# EasyEDA Pro project Geacon3.eprj, board Geacon_1 (continued)
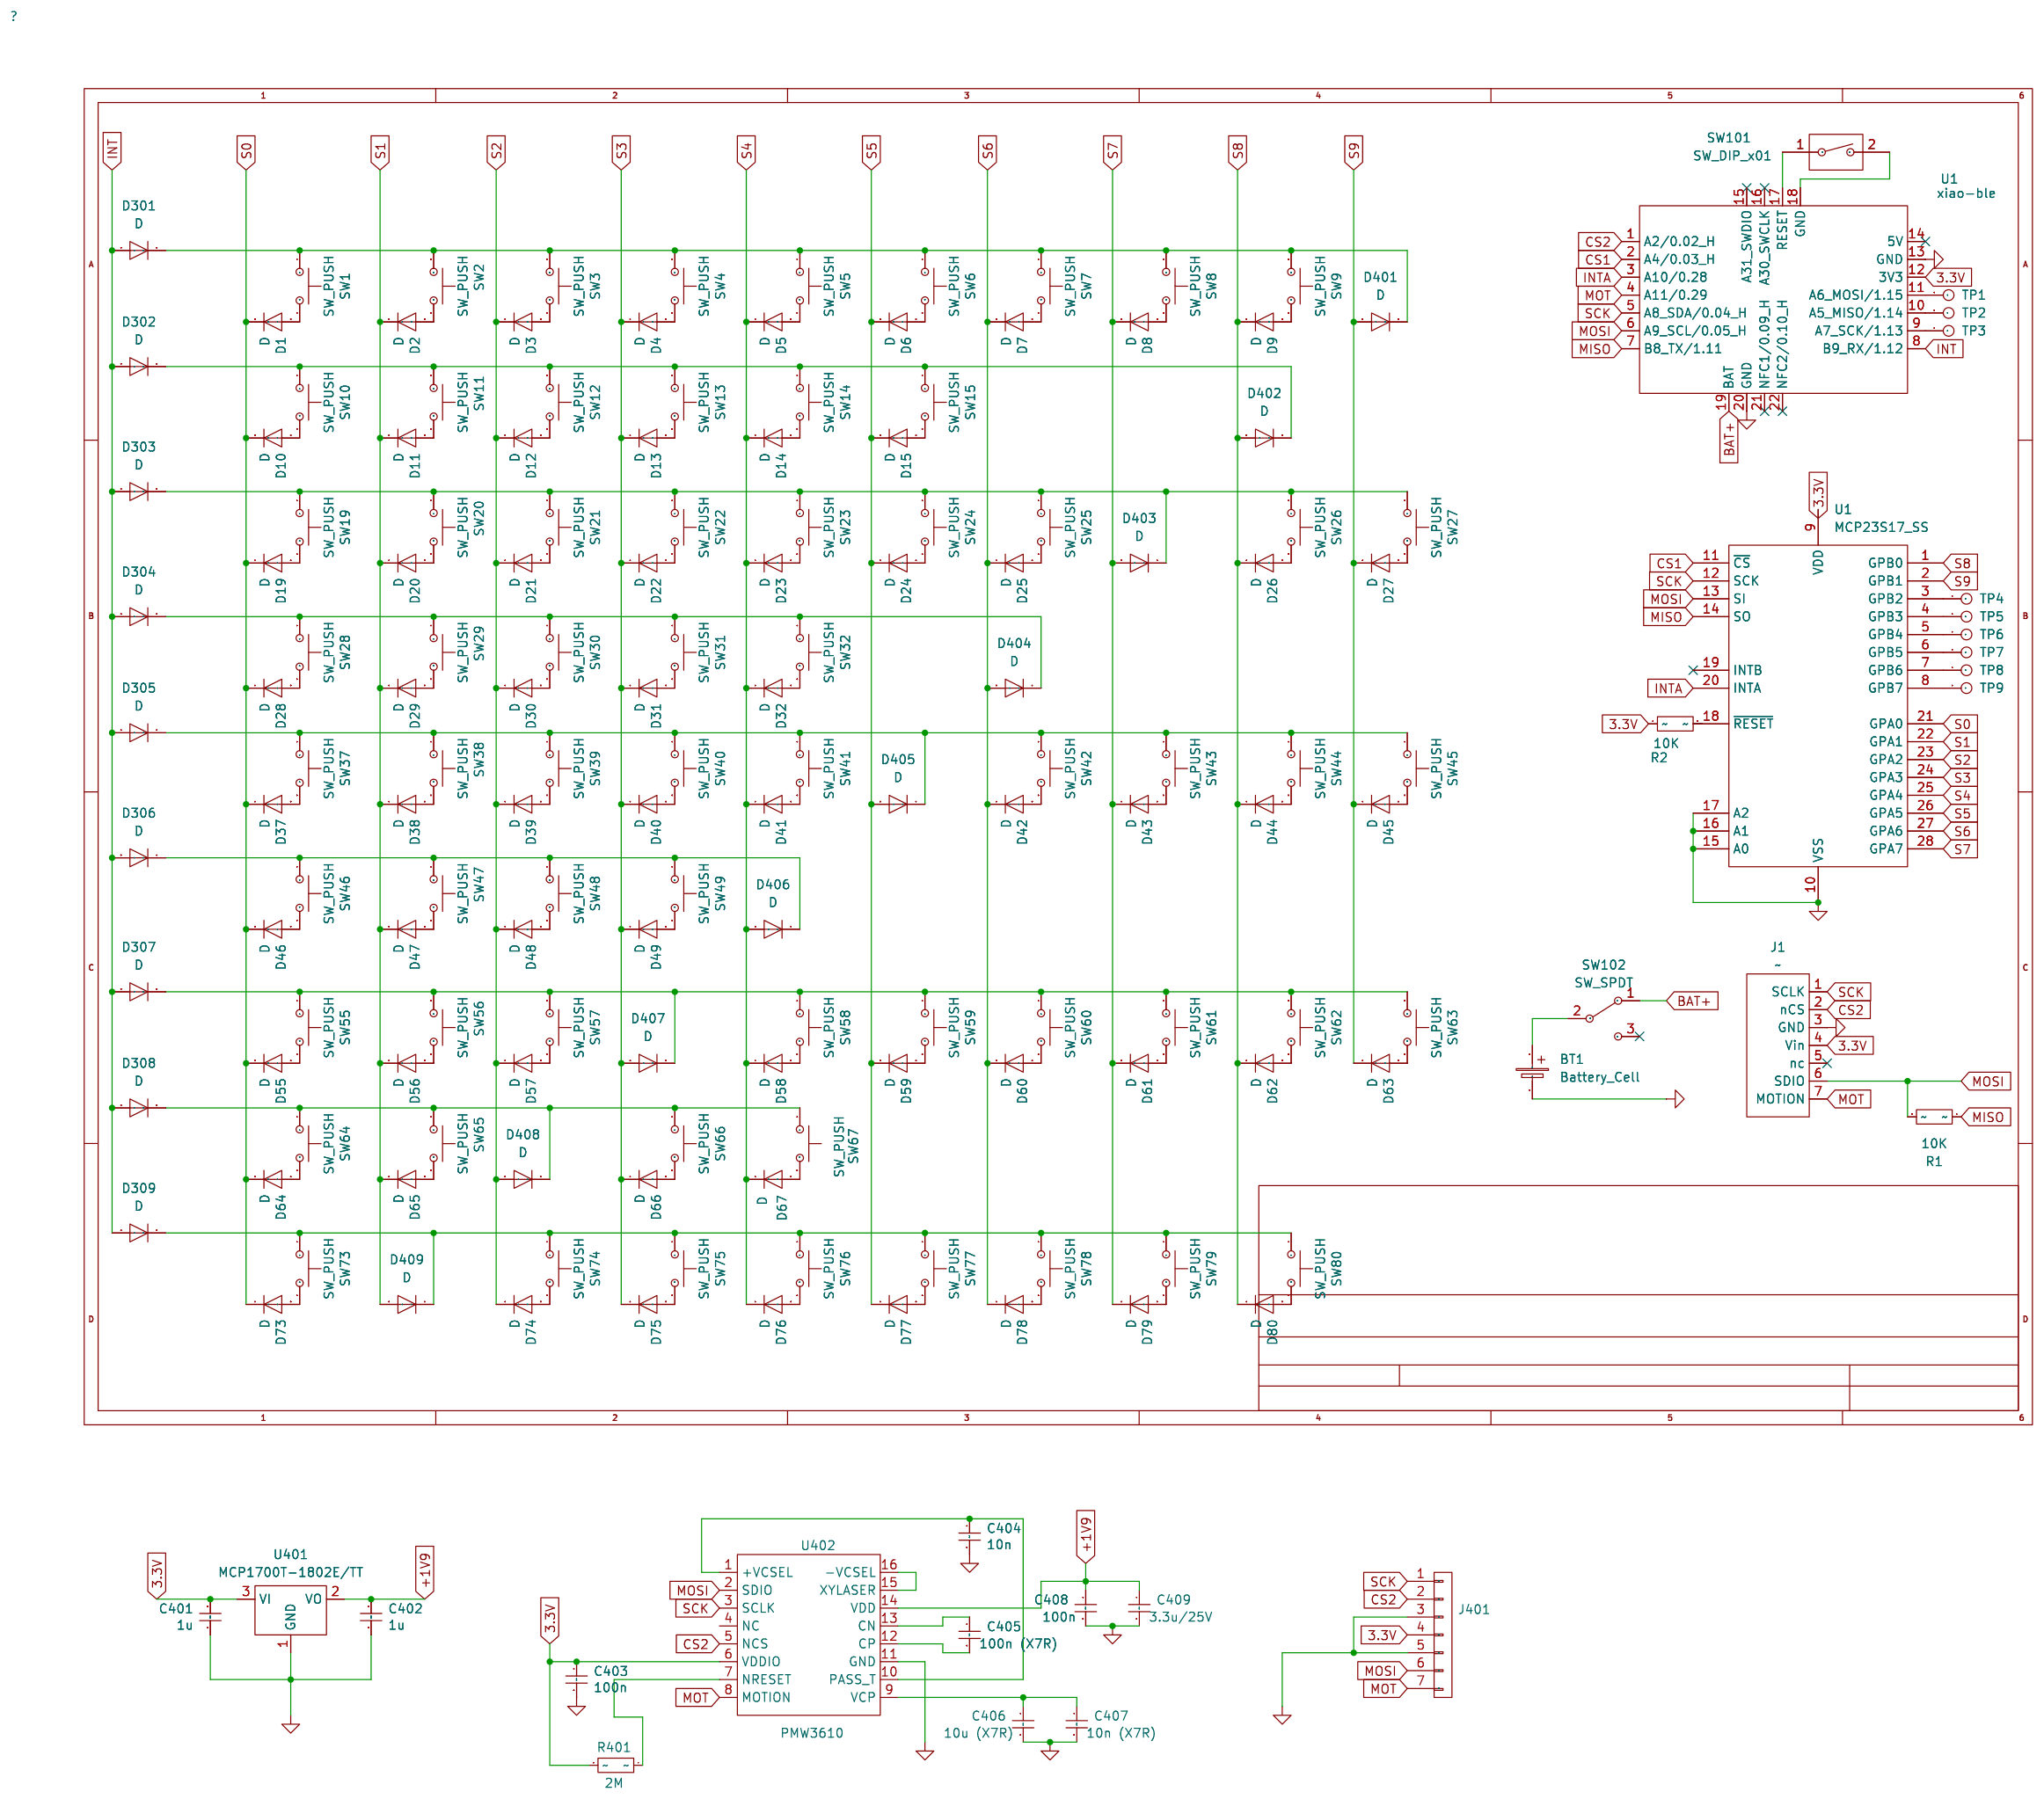
[diagram p0: schematic sheet]
## Routing (per net, layer and track width the routed paths; a pad name or vN(x,y) marks a point on that pad's centre or on a via; arc(x,y) is an arc through that point) (continued)
  Bottom Layer w0.25: 60.59,113.62 60.05,113.08 57.17,113.08 55.92,114.32 v1(55.92,115.95) ; v1(58.36,117.5) 58.47,117.6 62.27,117.6 64.67,115.2 72.3,115.2 72.44,115.06 v1(72.44,114.68) ; 128.93,106.19 102.23,106.19 101.93,106.49 100.09,106.49 99.79,106.19 97.15,106.19 96.85,106.49 88.66,106.49 88.36,106.19 82.99,106.19 v1(82.59,105.79)
MOSI: length 408.8
  Top Layer w0.25: v1(58.46,115.95) 60.03,115.95 62.57,118.49 62.57,118.88 63.03,119.34 63.59,119.34 63.65,119.28 65.6,119.28 69.01,122.68 82.88,122.68 89.23,116.33 118.09,116.33 121.68,112.73 121.68,111.55 121.29,111.15 121.29,110.59 122.23,109.65 127.29,109.65 133.32,103.62 144.22,103.62 147.09,106.5 165.85,106.5 168.86,109.51 v1(168.86,113.51) ; v1(237.15,16.22) 237.15,17.78 246.43,27.05 v1(246.43,28.32)
  Bottom Layer w0.25: v1(168.86,113.51) 168.98,113.63 286.19,113.63 291.38,108.44 291.38,39.41 280.78,28.81 246.91,28.81 v1(246.43,28.32) ; v1(237.15,16.22) 237.15,11.41 234.96,9.21 J1.6 ; v1(58.46,115.95) 58.72,115.95 59.59,115.08 61.14,115.08 61.24,114.98 61.24,112.66 60.79,112.21 56.57,112.21 56.28,112.5 55.92,112.5
MOT: length 318.6
  Top Layer w0.25: v1(244.18,28.13) 244.18,27.34 v1(237.83,20.99) ; 128.93,113.81 131.86,110.87 v1(134.66,110.87)
  Bottom Layer w0.25: J1.7 234.96,6.67 237.83,9.54 v1(237.83,20.99) ; v1(244.18,28.13) 245.66,29.62 280.45,29.62 290.57,39.74 290.57,108.11 285.86,112.82 169.7,112.82 169.02,112.14 168.96,112.14 160.44,103.62 139.95,103.62 134.66,108.91 v1(134.66,110.87)
NET-(BT1-+): length 25.4
  Top Layer w1: v1(30.03,118.03) 31.17,116.89 BT1.1
  Bottom Layer w1: v1(30.03,118.03) 29.8,118.26 SW102.2
NET-(D1-A): length 11.5
  Bottom Layer w0.25: SW1.2 18.41,107.17 18.45,107.21 19.2,106.46 19.2,100.25 18.45,99.49
NET-(D2-A): length 11.5
  Bottom Layer w0.25: 37.45,99.49 38.25,100.3 38.25,106.46 37.49,107.21 37.45,107.17 SW2.2
NET-(D3-A): length 11.7
  Bottom Layer w0.25: SW3.2 56.81,106.52 57.39,105.93 57.39,99.94 56.04,98.59
NET-(D4-A): length 11.9
  Bottom Layer w0.25: SW4.2 76,104.16 76.44,103.72 76.44,97.69 75.05,96.29 74.45,96.29
NET-(D5-A): length 12.5
  Bottom Layer w0.25: SW5.2 94.89,100.37 95.47,99.8 95.47,94.11 93.45,92.09 92.84,92.09
NET-(D6-A): length 11.9
  Bottom Layer w0.25: 112.65,89.59 114.28,91.22 114.28,97.23 114.08,97.43 113.77,97.74 SW6.2
NET-(D7-A): length 11.6
  Bottom Layer w0.25: 132.34,88.99 133.46,90.11 133.46,96.06 132.82,96.71 132.79,96.74 SW7.2
NET-(D8-A): length 11.5
  Bottom Layer w0.25: 152.25,89.94 152.64,90.34 152.64,96.52 151.55,97.61 151.31,97.37 148.4,97.37
NET-(D9-A): length 11.5
  Bottom Layer w0.25: 171.55,92.64 171.68,92.77 171.68,98.61 170.13,100.15 169.62,99.63 167.02,99.63
NET-(D10-A): length 11.7
  Bottom Layer w0.25: SW10.2 188.07,103.34 188.72,104 190.49,102.23 190.49,96.48 190.44,96.44
NET-(D11-A): length 12
  Bottom Layer w0.25: SW11.2 207.83,106.11 208.21,106.49 209.53,105.18 209.53,98.42 209.44,98.34
NET-(D12-A): length 11.9
  Bottom Layer w0.25: 224.69,107.17 227.74,107.17 227.84,107.28 228.71,106.42 228.71,99.51 228.34,99.14
NET-(D13-A): length 11.4
  Bottom Layer w0.25: 247.25,99.54 247.8,100.1 247.8,106.46 247.05,107.21 247,107.17 SW13.2
NET-(D14-A): length 34.6
  Bottom Layer w0.25: 250.24,94.74 252.45,94.74 254.72,97.01 SW14#2.2 269.13,97.01 272.46,100.34 SW14.2 275.58,107.17 275.62,107.21
NET-(D15-A): length 19.6
  Bottom Layer w0.25: 285.25,108.14 282.09,108.14 276.88,102.93 SW15.2 273.76,97.04 273.72,97
NET-(D19-A): length 11.8
  Bottom Layer w0.25: SW19.2 23.17,88.12 23.21,88.16 23.96,87.41 23.96,80.86 23.25,80.14
NET-(D20-A): length 11.5
  Bottom Layer w0.25: SW20.2 47.14,88.01 47.81,87.34 47.81,80.76 47.24,80.19
NET-(D21-A): length 11.8
  Bottom Layer w0.25: 65.45,78.39 66.94,79.88 66.94,86 66.74,86.2 66.43,86.5 SW21.2
NET-(D22-A): length 12
  Bottom Layer w0.25: SW22.2 85.5,83.3 86.07,82.72 86.07,77.07 83.95,74.94
NET-(D23-A): length 11.5
  Bottom Layer w0.25: SW23.2 104.31,79.8 104.75,79.36 104.75,73.69 102.95,71.89
NET-(D24-A): length 11.7
  Bottom Layer w0.25: 122.65,69.99 123.86,71.2 123.86,77.4 123.44,77.82 123.27,77.98 SW24.2
NET-(D25-A): length 11.8
  Bottom Layer w0.25: SW25.2 142.09,77.8 142.19,77.9 143.06,77.04 143.06,70.71 142.34,69.99
NET-(D26-A): length 11.8
  Bottom Layer w0.25: 161.94,71.79 162.19,72.03 162.19,78.31 160.87,79.63 160.49,79.24 SW26.2
NET-(D27-A): length 12.1
  Bottom Layer w0.25: 181.34,75.04 181.34,80.95 179.33,82.97 178.67,82.31 SW27.2
NET-(D28-A): length 12
  Bottom Layer w0.25: 200.15,78.49 200.15,84.7 198.44,86.41 197.92,85.89 SW28.2
NET-(D29-A): length 11.9
  Bottom Layer w0.25: SW29.2 217.77,87.8 218.02,88.05 219.11,86.96 219.11,80.35 218.75,79.99
NET-(D30-A): length 11.4
  Bottom Layer w0.25: 234.36,88.12 237.48,88.12 237.52,88.16 238.28,87.41 238.28,81.02 237.75,80.49
NET-(D31-A): length 11.8
  Bottom Layer w0.25: SW31.2 256.53,88.12 256.57,88.16 257.32,87.41 257.32,80.97 256.55,80.19
NET-(D32-A): length 44.8
  Bottom Layer w0.25: 262.85,80.24 262.85,85.03 265.93,88.12 SW32.2 280.34,88.12 280.38,88.16 282.17,86.37 SW32#2.2 282.17,67.83 282.21,67.79
NET-(D37-A): length 11.3
  Bottom Layer w0.25: 26.05,61.39 26.34,61.69 26.34,68.36 25.59,69.11 25.55,69.07 SW37.2
NET-(D38-A): length 11.8
  Bottom Layer w0.25: 48.91,68.75 51.97,68.75 52.07,68.65 52.6,68.11 52.6,61.75 51.54,60.69
NET-(D39-A): length 11.9
  Bottom Layer w0.25: 70.34,58.39 71.69,59.73 71.69,66.35 71.22,66.81 SW39.2
NET-(D40-A): length 12.1
  Bottom Layer w0.25: SW40.2 90.21,63.18 90.86,62.54 90.86,57.3 88.34,54.79
NET-(D41-A): length 11.8
  Bottom Layer w0.25: SW41.2 109.03,60.15 109.41,59.77 109.5,59.68 109.5,52.94 108.34,51.79
NET-(D42-A): length 11.7
  Bottom Layer w0.25: 127.75,50.69 128.66,51.61 128.66,57.19 128.13,57.72 128.13,58.63 128.03,58.73 SW42.2
NET-(D43-A): length 11.3
  Bottom Layer w0.25: SW43.2 146.7,58.95 146.88,59.13 147.86,58.15 147.86,51.8 147.65,51.59
NET-(D44-A): length 11.5
  Bottom Layer w0.25: SW44.2 165.06,60.81 165.51,61.26 167.05,59.73 167.05,53.69
NET-(D45-A): length 12.2
  Bottom Layer w0.25: SW45.2 183.17,64.28 183.89,65.01 186.44,62.45 186.44,57.29
NET-(D46-A): length 11.8
  Bottom Layer w0.25: 204.75,60.04 204.75,60.04 204.75,66.5 203.32,67.93 202.87,67.48 SW46.2
NET-(D47-A): length 11.8
  Bottom Layer w0.25: 223.65,61.04 223.91,61.31 223.91,68.17 222.93,69.14 222.75,68.97 219.78,68.97
NET-(D48-A): length 11.8
  Bottom Layer w0.25: SW48.2 242.24,69.07 242.28,69.11 243.04,68.36 243.04,61.38 242.65,60.99
NET-(D49-A): length 32.2
  Bottom Layer w0.25: 248.65,61.24 259.47,61.24 261.84,58.87 261.88,58.91 SW49#2.2 265,65.46 261.35,69.11 261.31,69.07 SW49.2
NET-(D55-A): length 11.9
  Bottom Layer w0.25: 30.25,42.04 31.11,42.9 31.11,49.31 30.35,50.06 30.31,50.02 SW55.2
NET-(D56-A): length 11.8
  Bottom Layer w0.25: 60.84,40.79 62.17,42.12 62.17,48.4 61.86,48.71 61.62,48.94 SW56.2
NET-(D57-A): length 12.5
  Bottom Layer w0.25: SW57.2 80.76,46.16 81.27,45.65 81.27,39.51 79.15,37.39
NET-(D58-A): length 12.2
  Bottom Layer w0.25: 98.05,33.89 100.1,35.95 100.1,41.9 99.59,42.41 SW58.2
NET-(D59-A): length 12
  Bottom Layer w0.25: 118.05,31.79 119.07,32.81 119.07,39.64 118.52,40.19 SW59.2
NET-(D60-A): length 11.9
  Bottom Layer w0.25: 137.25,31.59 138.26,32.61 138.26,38.87 137.51,39.63 137.47,39.59 SW60.2
NET-(D61-A): length 11.7
  Bottom Layer w0.25: 153.07,40.63 155.9,40.63 156.22,40.94 157.42,39.74 157.42,33.42 157.15,33.14
NET-(D62-A): length 12.1
  Bottom Layer w0.25: 176.84,35.99 176.84,41.78 174.74,43.88 174.15,43.3 SW62.2
NET-(D63-A): length 12.1
  Bottom Layer w0.25: 195.55,39.69 195.55,45.66 193.57,47.63 192.99,47.04 190.47,47.04
NET-(D64-A): length 11.7
  Bottom Layer w0.25: SW64.2 212.8,49.39 213.11,49.7 214.32,48.5 214.32,41.91 214.25,41.84
NET-(D65-A): length 11.8
  Bottom Layer w0.25: SW65.2 232.72,50.02 232.76,50.06 233.51,49.31 233.51,42.66 232.84,41.99
NET-(D66-A): length 11.9
  Bottom Layer w0.25: SW66.2 251.77,50.02 251.81,50.06 252.56,49.31 252.56,42.96 251.65,42.04
NET-(D67-A): length 11.6
  Bottom Layer w0.25: 275.64,37.49 276.38,38.22 276.38,44.54 275.62,45.3 275.58,45.26 SW67.2
NET-(D73-A): length 11.6
  Bottom Layer w0.25: SW73.2 20.79,30.97 20.83,31.01 21.58,30.26 21.58,24.23 20.64,23.29
NET-(D74-A): length 11.6
  Bottom Layer w0.25: 44.84,23.09 45.39,23.64 45.39,30.26 44.64,31.01 44.6,30.97 SW74.2
NET-(D75-A): length 11.8
  Bottom Layer w0.25: SW75.2 69.31,28.98 69.79,28.5 69.79,22.33 68.25,20.79
NET-(D76-A): length 11.9
  Bottom Layer w0.25: SW76.2 96.24,23.69 96.86,23.07 96.86,17.9 94.45,15.49
NET-(D77-A): length 11.8
  Bottom Layer w0.25: 137.25,12.89 138.26,13.91 138.26,20.02 137.51,20.78 137.47,20.74 SW77.2
NET-(D78-A): length 11.8
  Bottom Layer w0.25: 256.75,18.19 257.32,18.77 257.32,25.04 256.57,25.8 256.57,26.25 256.53,26.21 SW78.2
NET-(D79-A): length 11.6
  Bottom Layer w0.25: 275.64,18.39 276.38,19.12 276.38,25.49 275.62,26.25 275.58,26.21 SW79.2
NET-(D80-A): length 22.2
  Bottom Layer w0.25: 283.44,18.54 293.79,18.54 295.43,20.17 295.43,25.49 294.67,26.25 294.63,26.21 291.51,26.21
NET-(D301-K): length 260.1
  Top Layer w0.25: v1(119.43,113.41) 119.43,111.5 121.78,109.15 122.59,109.15 137.32,94.42 SW8.1
  Bottom Layer w0.25: 157.97,95.7 157.87,95.6 157.87,87.29 158.8,86.36 ; 157.97,95.7 154.1,99.57 144.37,99.57 139.05,94.25 ; 157.97,95.7 158.41,96.15 SW9.1 ; 101.17,96.29 98.33,99.14 98.33,100.81 96.69,102.45 95.59,102.45 95.58,102.43 95.01,102.43 95,102.45 85.18,102.45 82.52,99.78 ; 101.17,96.29 104.7,99.81 116.51,99.81 120.06,96.26 120.06,94.44 ; 101.17,96.29 101.56,95.9 SW6.1 ; 24.8,104.67 29.37,109.25 39.54,109.25 44.13,104.65 ; 24.8,104.67 24.84,104.63 SW2.1 ; 24.8,104.67 24.8,105.11 20.66,109.25 10.32,109.25 5.75,104.67 5.79,104.63 SW1.1 ; 139.05,94.25 139.05,94.52 134.76,98.81 124.43,98.81 120.06,94.44 ; 139.05,94.25 139.21,94.42 SW8.1 ; 44.13,104.65 44.38,104.4 47.31,104.4 ; 44.13,104.65 48.08,108.6 58.74,108.6 60.76,106.58 60.76,105.89 63.5,103.14 ; 63.5,103.14 64.03,102.62 SW4.1 ; 63.5,103.14 66.6,106.24 78.34,106.24 82.52,102.06 82.52,99.78 ; 82.52,99.78 84.98,99.78 SW5.1 ; 120.06,94.44 120.17,94.33 SW7.1 ; 119.43,115.57 v1(119.43,113.41)
NET-(D302-K): length 259.2
  Top Layer w0.25: v1(121.97,108.33) 143.56,86.74 v1(175.31,86.74) ; 199.04,102.89 196.51,105.42 183.23,105.42 179.9,102.09 SW10.1 181.65,97.86 181.65,91.81 v1(179.12,89.28)
  Bottom Layer w0.25: 234.34,104.67 234.38,104.63 SW13.1 ; 234.34,104.67 234.34,104.85 230.52,108.68 230.45,108.68 229.93,109.2 219.94,109.2 215.23,104.5 ; 234.34,104.67 238.87,109.2 249.05,109.2 249.57,108.68 251.16,108.68 255.17,104.67 262.92,104.67 ; 215.23,104.5 215.2,104.47 211.13,108.54 201.81,108.54 195.86,102.58 196.17,102.89 199.04,102.89 ; 215.23,104.5 SW12.1 ; 262.92,104.67 267.52,109.27 285.75,109.27 286.42,108.59 286.42,99.54 286.38,99.58 SW15.1 ; 262.92,104.67 262.92,100.82 SW14#2.1 267.34,99.55 267.38,99.51 ; 262.92,104.67 262.96,104.63 SW14.1 ; v1(121.97,108.33) 124.01,110.38 124.01,111.19 123.43,111.77 119.42,111.77 115.62,115.57 ; v1(175.31,86.74) 175.69,86.74 178.22,89.28 v1(179.12,89.28) ; 176.76,99.03 177.34,99.61 SW10.1
NET-(D303-K): length 262.8
  Top Layer w0.25: v1(120.7,98.17) 120.7,96.9 120.55,96.76 120.55,86.64 123.23,83.96 v1(123.23,81.28) ; v1(111.81,112.14) 112.83,112.14 118.88,106.09 v1(118.88,105.24)
  Bottom Layer w0.25: 128.31,81.28 142.96,81.28 148.52,75.72 148.83,76.03 ; 128.31,81.28 v1(123.23,81.28) 115.77,81.28 110.6,76.11 ; 128.31,81.28 128.31,76.33 129.55,75.09 129.58,75.12 SW25.1 ; v1(118.88,105.24) 118.88,105.07 120.7,103.25 v1(120.7,98.17) ; 110.6,76.11 110.85,75.86 SW24.1 ; 110.6,76.11 110.6,77.44 106.16,81.88 94.9,81.88 91.81,78.78 ; 57,84.67 54.22,84.67 53.84,85.06 ; 73.12,82.71 75.79,85.37 87.3,85.37 91.81,80.86 91.81,78.78 ; 73.12,82.71 73.12,83.79 68.33,88.58 57.36,88.58 53.84,85.06 ; 73.12,82.71 73.78,82.05 SW22.1 ; 37.6,85.61 34.53,85.61 34.42,85.72 ; 91.81,78.78 92.33,78.26 SW23.1 ; 34.42,85.72 29.94,90.2 15.08,90.2 10.51,85.62 10.55,85.58 SW19.1 ; 34.42,85.72 39.25,90.55 48.65,90.55 53.84,85.36 53.84,85.06 ; 148.83,76.03 154,81.2 156.83,81.2 156.9,81.27 158.57,81.27 158.64,81.2 159.34,81.2 159.76,81.62 162.91,81.62 165.95,78.58 SW27.1 ; 148.83,76.03 SW26.1 ; 111.81,115.57 v1(111.81,112.14)
NET-(D304-K): length 240.5
  Top Layer w0.249: v2(265,89.98) 266.96,88.03 271.1,88.03 271.28,87.85 271.28,86.84
  Top Layer w0.25: v1(108.01,112.02) 110.77,112.02 v1(117.49,105.3) ; v1(119.43,100.71) 121.37,100.71 129.1,92.98 132.66,92.98 133.46,92.17 133.46,83.52 v1(134.66,82.31)
  Bottom Layer w0.249: v2(265,89.98) 264.62,89.98 261.96,92.65 249.81,92.65 249.46,92.3 249.14,92.3 248.85,92 248.85,91.69 243.87,86.7 243.87,86.07 SW31.1 247.02,85.62 SW31.1 ; 141.02,82.55 142.9,82.55 143.85,81.6 156.66,81.6 156.73,81.67 158.74,81.67 158.81,81.6 159.17,81.6 159.59,82.02 163.08,82.02 163.5,81.6 170.13,81.6 173.56,85.03 178.29,85.03 178.39,85.13 181.21,85.13 181.31,85.03 182.7,85.03 SW28.1
  Bottom Layer w0.25: v1(134.66,82.31) 134.91,82.55 141.02,82.55 ; SW29.1 205.68,84.86 205.51,84.69 ; 243.87,86.07 239.38,90.55 229.75,90.55 224.82,85.62 ; SW30.1 224.86,85.58 224.82,85.62 ; 224.82,85.62 220.43,90.01 210.84,90.01 205.51,84.69 ; 267.68,85.62 267.68,85.69 269.32,87.33 270.89,87.33 271.76,86.46 ; v1(108.01,112.02) 108,112.03 108,115.57 ; 205.51,84.69 201.66,88.53 192.84,88.53 186.72,82.41 SW28.1 ; v1(119.43,100.71) 117.38,102.76 117.38,105.19 v1(117.49,105.3) ; 279.63,77.3 279.63,80.45 279.67,80.49 273.87,80.49 272,82.36 272,85.58
NET-(D305-K): length 287.1
  Top Layer w0.25: v1(104.26,112.14) 104.01,112.14 101.65,109.78 v1(101.65,105.82) ; SW41.1 104.73,63.54 104.73,82.39 100.38,86.74 v1(100.38,99.44)
  Bottom Layer w0.25: SW38.1 39.45,66.48 39.27,66.66 ; SW37.1 12.93,66.53 12.89,66.57 17.46,71.15 34.79,71.15 39.27,66.66 ; 58.67,65.58 58.67,66.21 54.07,70.82 43.43,70.82 39.27,66.66 ; 58.67,65.58 61.98,68.89 73.1,68.89 77.91,64.08 77.91,62.81 ; 58.67,65.58 59.13,65.12 SW39.1 ; SW44.1 153.63,57.46 153.25,57.08 ; 114.34,62.23 99.8,62.23 96.48,58.91 ; 114.34,62.23 128.56,62.23 134.3,56.49 134.3,56.04 ; 114.34,62.23 114.34,57.64 115.51,56.47 SW42.1 ; v1(101.65,105.82) 101.65,100.71 v1(100.38,99.44) ; 77.91,62.81 80.28,62.81 SW40.1 ; 77.91,62.81 80.36,65.26 91.98,65.26 96.48,60.75 96.48,58.91 ; 134.3,56.04 139.31,61.05 149.29,61.05 153.25,57.08 ; 134.3,56.04 134.4,56.14 137.49,56.14 ; 104.19,115.57 104.19,112.21 v1(104.26,112.14) ; SW41.1 96.94,58.46 96.48,58.91 ; 153.25,57.08 159.51,63.35 168.47,63.35 172.04,59.78 174.51,59.78 SW45.1
NET-(D306-K): length 263.3
  Top Layer w0.25: v1(99.11,100.71) 99.11,77.76 101.65,75.22 101.65,65.15 v1(102.92,63.88) ; v1(100.38,112.14) v1(100.38,105.82)
  Bottom Layer w0.25: v1(102.92,63.88) 177.48,63.88 180.51,66.92 182.71,66.92 182.99,67.2 185.73,67.2 186.02,66.92 187.9,66.92 191.06,63.75 194.23,66.92 194.53,66.92 197.63,70.01 206.39,70.01 210.35,66.05 ; 248.97,72.39 235.4,72.39 229.58,66.57 ; 248.97,72.39 249.45,72.87 262.25,72.87 271.24,63.88 271.24,63.1 272,62.34 272,61.41 274.54,61.41 ; 248.97,72.39 248.97,66.89 248.65,66.57 248.69,66.53 SW49.1 ; v1(99.11,100.71) 99.65,101.26 99.65,105.09 v1(100.38,105.82) ; 210.35,66.05 210.45,66.15 SW47.1 ; 210.35,66.05 215.36,71.06 225.28,71.06 229.58,66.75 229.58,66.57 ; 100.38,115.57 v1(100.38,112.14) ; 229.58,66.57 229.62,66.53 SW48.1 ; 191.44,64.13 194.23,64.13
NET-(D307-K): length 325.5
  Top Layer w0.25: v1(96.56,112.14) v1(96.56,105.82) ; 109.06,38.21 108.37,38.21 93.63,52.95 93.63,67.94 87.67,73.9 87.67,83.74 85.38,86.03 85.38,89.31 89.26,93.18 90,93.18 91.58,94.77 91.58,95.51 94.79,98.71 94.79,99.36 94.79,99.37 94.79,100.07 v1(97.84,103.11)
  Bottom Layer w0.25: 87.15,41.61 90.03,44.49 99.62,44.49 100.05,44.06 101.85,44.06 105.88,40.02 105.88,38.53 ; 87.15,41.61 87.15,46.24 83.87,49.53 72.5,49.53 68.32,45.35 ; 87.15,41.61 87.75,41.01 90.29,41.01 ; 96.56,115.57 v1(96.56,112.14) ; 48.99,47.28 54.15,52.45 62.27,52.45 68.32,46.41 68.32,45.35 ; 48.99,47.28 37.38,47.28 32.57,52.1 22.23,52.1 17.65,47.52 17.69,47.48 SW55.1 ; 48.99,47.28 49.3,46.97 SW56.1 ; 143.79,37.31 144.03,37.54 146.97,37.54 ; 143.79,37.31 150.04,43.56 158.29,43.56 162.67,39.18 169.21,45.72 173.47,45.72 173.76,46 176.66,46 176.95,45.72 178.71,45.72 180.99,43.44 184.66,43.44 ; 143.79,37.31 143.79,38.25 139.75,42.29 130.01,42.29 124.81,37.09 ; 109.06,38.21 106.2,38.21 105.88,38.53 ; SW60.1 124.85,37.05 124.81,37.09 ; v1(96.56,105.82) 97.84,104.55 v1(97.84,103.11) ; 68.32,45.35 68.91,44.76 SW57.1 ; 124.81,37.09 124.81,37.89 120.41,42.29 109.65,42.29 105.88,38.53 ; 163.19,39.69 SW62.1
NET-(D308-K): length 281.5
  Top Layer w0.25: v1(100.58,45.04) 95.75,49.88 95.75,50.27 93.23,52.79 93.23,67.77 87.27,73.73 87.27,83.57 84.98,85.86 84.98,89.47 89.09,93.59 89.83,93.59 91.18,94.93 91.18,96.32 94.39,99.53 94.39,100.38 95.3,101.28 v1(95.3,103.11) ; v1(92.76,112.14) v1(92.76,105.82)
  Bottom Layer w0.25: 92.76,115.57 v1(92.76,112.14) ; 220.06,47.52 215.13,52.45 207.07,52.45 200.68,46.06 200.3,46.06 196.95,49.41 195.83,49.41 195.5,49.75 192.59,49.75 192.26,49.41 189.16,49.41 185.86,46.12 177.12,46.12 176.83,46.41 173.59,46.41 173.3,46.12 102.04,46.12 100.96,45.04 v1(100.58,45.04) ; 220.06,47.52 227.15,54.61 237.53,54.61 237.53,49.09 239.11,47.52 ; 220.06,47.52 220.1,47.48 SW65.1 ; 239.11,47.52 244.04,52.45 253.67,52.45 262.92,43.2 262.92,42.76 262.96,42.72 SW67.1 ; 239.11,47.52 239.15,47.48 SW66.1 ; v1(92.76,105.82) 92.76,105.65 v1(95.3,103.11) ; SW64.1 200.92,46.3
NET-(D309-K): length 440.6
  Top Layer w0.25: v1(101.65,25.76) 101.65,43.02 95.34,49.32 95.34,50.1 92.82,52.62 92.82,67.6 86.87,73.56 86.87,83.41 84.58,85.69 84.58,85.89 82.52,87.95 82.52,101.91 v1(83.87,103.25) ; v1(88.95,112.14) v1(88.95,105.82)
  Bottom Layer w0.25: 83.91,23.22 86.45,25.76 v1(101.65,25.76) 120.71,25.76 124.81,21.67 124.81,18.24 124.85,18.2 SW77.1 136.85,27.05 163.72,27.05 169.23,32.56 169.38,32.56 169.88,33.06 175.75,33.06 176.13,33.43 178.02,33.43 178.9,34.31 195,34.31 195.26,34.57 196.55,34.57 196.96,34.97 238.12,34.97 238.81,34.29 238.81,28.77 243.87,23.71 ; 83.91,23.22 86.32,23.22 87.02,22.52 ; 83.91,23.22 81.98,23.22 74.14,31.06 60.13,31.06 56.74,27.66 ; 243.87,23.71 248.44,28.28 259.16,28.28 262.92,24.53 262.92,23.71 ; 243.87,23.71 243.91,23.67 SW78.1 ; SW79.1 262.96,23.67 262.92,23.71 ; 262.92,23.71 267.5,28.28 278.21,28.28 281.97,24.53 281.97,23.71 282.01,23.67 SW80.1 ; SW74.1 31.98,28.43 31.94,28.47 ; 88.95,115.57 v1(88.95,112.14) ; 31.94,28.47 31.94,28.47 36.52,33.05 51.36,33.05 56.74,27.66 ; 31.94,28.47 27.36,33.05 12.7,33.05 8.13,28.47 8.17,28.43 SW73.1 ; 59.9,27.24 57.17,27.24 56.74,27.66 ; v1(88.95,105.82) 88.95,105.79 86.41,103.25 v1(83.87,103.25)
NET-(SW101-PAD2): length 131.8
  Top Layer w0.25: v1(133.4,123.57) 39.38,123.57 34.63,118.81 17.44,118.81 v2(14.57,115.95)
  Bottom Layer w0.25: v1(133.4,123.57) 138.47,123.57 138.84,123.21 138.84,120.86 137.81,119.84 ; v2(14.57,115.95) SW101.2
NET-(U1-GPB2): length 34.2
  Top Layer w0.25: v1(62.6,107.95) 63.39,107.95 65.06,106.29 67.85,106.29 v1(71.17,109.6)
  Bottom Layer w0.25: TP4.1 50.02,110.42 60.13,110.42 v1(62.6,107.95) ; 67.74,113.62 67.74,112.5 69.86,110.38 70.39,110.38 v1(71.17,109.6)
NET-(U1-GPB3): length 37.3
  Top Layer w0.25: v1(69.9,109.6) 69.17,110.33 68.32,110.33 68.13,110.13 68.13,109.28 66.82,107.97 v1(64.47,107.97)
  Bottom Layer w0.25: v1(64.47,107.97) 63.49,107.97 63.27,108.19 63.27,108.23 62.88,108.63 62.83,108.63 60.97,110.5 60.97,111.04 60.2,111.81 59.41,111.81 59.25,111.65 51.15,111.65 47.98,114.82 44.88,114.82 TP5.1 ; 67.09,113.62 67.09,112.5 69.9,109.69 v1(69.9,109.6)
NET-(U1-GPB4): length 37.8
  Top Layer w0.25: v1(68.88,109.52) 68.88,109.39 66.68,107.2 v1(65.38,107.2)
  Bottom Layer w0.25: 66.44,113.62 66.44,112.25 68.88,109.81 v1(68.88,109.52) ; v1(65.38,107.2) 62.94,107.2 62.83,107.09 62.16,107.09 59.3,109.95 58.93,109.95 58.9,109.97 43.36,109.97 TP6.1
NET-(U1-GPB5): length 44.2
  Top Layer w0.25: v1(67.36,109.6) 62.94,109.6 61.83,108.49 61.83,107.77 v1(63.16,106.43)
  Bottom Layer w0.25: TP7.1 37.12,113.41 41.48,109.05 58.93,109.05 61.34,106.64 61.34,105.97 61.77,105.54 62.44,105.54 63.16,106.26 v1(63.16,106.43) ; v1(67.36,109.6) 67.36,110.7 65.79,112.26 65.79,113.62
NET-(U1-GPB6): length 44.8
  Top Layer w0.25: v1(62.12,106.31) 61.67,106.31 61.42,106.56 61.42,108.65 62.87,110.1 65.31,110.1 v1(66.09,110.87)
  Bottom Layer w0.25: v1(62.12,106.31) 61.99,106.31 61.79,106.51 61.79,106.83 59.12,109.5 58.74,109.5 58.72,109.52 42.03,109.52 37.24,114.31 33.71,114.31 TP8.1 ; 65.14,113.62 65.14,112.45 65.27,112.33 65.27,111.69 v1(66.09,110.87)
NET-(U1-GPB7): length 42.6
  Top Layer w0.25: v1(59.8,111.11) 60.04,110.87 v1(64.81,110.87)
  Bottom Layer w0.25: 64.49,113.62 64.49,111.2 v1(64.81,110.87) ; TP9.1 29.26,113.54 30.61,114.89 40.22,114.89 42.84,112.27 44.11,112.27 46.26,114.41 47.81,114.41 50.99,111.23 59.68,111.23 v1(59.8,111.11)
NET-(U1-~{RESET}): length 21.6
  Bottom Layer w0.25: 62.54,120.82 62.48,120.76 62.48,118.54 64.57,116.45 74.12,116.45 76.32,114.25 76.32,113.88 76.71,113.48 77.09,113.48 78.79,111.78
NET-(U101-A5_MISO{SLASH}1.14): length 18.4
  Bottom Layer w0.25: 144.16,111.27 144.56,110.87 158.8,110.87 TP2.1
NET-(U101-A6_MOSI{SLASH}1.15): length 13.5
  Bottom Layer w0.25: TP1.1 144.56,113.41 144.16,113.81
NET-(U101-A7_SCK{SLASH}1.13): length 22.9
  Bottom Layer w0.25: 144.16,108.73 160.46,108.73 TP3.1
NET-(U101-RESET): length 119.5
  Top Layer w0.25: 135.27,119.84 135.22,119.9 arc(134.94,119.85) 134.7,119.99 129.49,119.99 129.41,120.07 127.49,120.07 127.41,119.99 v1(125.9,119.99) ; v1(76.99,114.16) 76.47,114.68 v1(73.7,114.68)
  Bottom Layer w0.25: 21.07,115.95 47.42,115.95 49.57,118.1 57.87,118.1 58.04,118.28 61.86,118.28 62.13,118 62.44,118 64.5,115.95 72.44,115.95 v1(73.7,114.68) ; v1(76.99,114.16) 80.8,114.16 86.76,120.11 125.78,120.11 v1(125.9,119.99)
S0: length 417.7
  Top Layer w0.25: v1(215.94,39.54) 215.94,46.34 207.06,55.23 v1(207.06,56.26) 207.06,70.23 v1(201.97,75.31) 201.97,84.2 v1(193.09,93.09) ; v1(24.18,20.7) 31.8,28.32 v1(31.8,39.75) 31.8,56.26 v1(29.26,58.8) 26.71,61.34 v1(26.71,76.58) 26.71,94.11 v1(27.35,94.74) 31.54,94.74 40.23,103.44 40.23,107.25 43.04,110.05 54.7,110.05 v1(63.31,118.66)
  Bottom Layer w0.25: v1(27.35,94.74) 25.9,96.19 18.45,96.19 ; v1(193.09,93.09) 193.04,93.14 190.44,93.14 ; v1(26.71,76.58) 26.46,76.84 23.25,76.84 ; v1(24.18,20.7) 22.91,20.7 22.19,19.99 20.64,19.99 ; v1(31.8,39.75) 31.8,39.12 31.04,38.36 ; v1(63.31,118.66) 64.49,119.84 64.49,120.82 ; 31.04,38.36 31.04,37.44 34.92,33.55 72.64,33.55 77.14,29.05 97.07,29.05 97.2,28.92 98.63,28.92 98.77,29.05 98.91,29.05 99.46,29.6 155.38,29.6 155.89,30.11 155.89,30.17 156.05,30.33 156.18,30.33 156.43,30.58 157.63,30.58 160.51,33.46 175.46,33.46 175.58,33.58 175.71,33.58 175.96,33.84 177.73,33.84 178.97,35.07 194.34,35.07 194.7,34.72 194.84,34.72 195.09,34.97 196.38,34.97 196.79,35.37 212.09,35.37 215.94,39.22 v1(215.94,39.54) ; 31.04,38.36 30.74,38.66 D55.1 ; 204.75,56.74 205.22,56.26 v1(207.06,56.26) ; 26.05,58.09 28.54,58.09 v1(29.26,58.8) ; 200.15,75.19 200.27,75.31 v1(201.97,75.31)
S1: length 382.6
  Top Layer w0.25: v1(63.54,39.75) 63.54,47.04 53.38,57.2 v1(53.38,57.53) 53.38,72.77 v1(49.57,76.58) 49.57,88.01 v1(40.68,96.9) 40.68,107.06 43.22,109.6 55.29,109.6 64.02,118.33 v1(64.3,118.33) ; v1(221.03,94.36) v1(221.03,77.85) 221.03,76.58 226.11,71.5 v1(226.11,57.53) 235,48.64 v1(235,38.48)
  Bottom Layer w0.25: 47.24,76.89 47.55,76.58 v1(49.57,76.58) ; 209.44,95.04 220.35,95.04 v1(221.03,94.36) ; 65.14,120.82 65.14,119.46 64.58,118.9 64.58,118.72 64.3,118.44 v1(64.3,118.33) ; v1(226.11,57.53) 225.9,57.74 223.65,57.74 ; 218.75,76.69 219.86,76.69 v1(221.03,77.85) ; 238.81,37.59 237.16,37.59 236.27,38.48 v1(235,38.48) 234.74,38.23 233.18,38.23 231.19,40.22 197.84,40.22 193.86,36.24 178.93,36.24 178.42,35.73 178.35,35.73 177.58,34.96 160.74,34.96 157.65,31.88 156.38,31.88 155.27,30.77 102.88,30.77 101.77,31.88 101.23,31.88 100.5,32.6 81.89,32.6 80.02,34.47 80.02,34.67 79.86,34.83 79.66,34.83 76.27,38.23 64.94,38.23 63.54,39.62 v1(63.54,39.75) 61.28,37.49 60.84,37.49 ; 37.45,96.19 39.97,96.19 v1(40.68,96.9) ; v1(53.38,57.53) 51.69,57.53 51.54,57.39
S2: length 376.2
  Top Layer w0.25: v1(48.3,20.7) 61,33.4 v1(76.25,33.4) 77.14,34.3 77.14,43.94 72.44,48.64 v1(72.44,53.72) 72.44,70.23 v1(67.36,75.31) 67.36,85.68 v1(58.67,94.36) ; v1(58.67,94.36) 58.51,94.52 58.51,112.19 63.7,117.38 v1(64.59,117.38) ; v1(58.67,94.36) 58.46,94.36 ; v1(245.16,59.86) 243.04,61.98 243.04,74.89 v1(240.08,77.85) 240.08,90.55 235,95.63 v1(233.72,95.63)
  Bottom Layer w0.25: 70.34,55.09 71.71,53.72 v1(72.44,53.72) 72.56,53.85 91.74,53.85 96.29,49.29 128.88,49.29 129.18,49.59 148.18,49.59 149.88,51.29 167.18,51.29 170.99,55.1 186.79,55.1 190.33,58.64 236.55,58.64 237.38,57.82 242.39,57.82 244.44,59.86 v1(245.16,59.86) ; v1(76.25,33.4) 76.93,34.09 79.15,34.09 ; v1(64.59,117.38) 65.03,117.82 65.03,118.71 65.79,119.47 65.79,120.82 ; 65.45,75.09 65.67,75.31 v1(67.36,75.31) ; 237.75,77.19 239.41,77.19 v1(240.08,77.85) ; v1(58.67,94.36) 57.74,95.29 56.04,95.29 ; 44.84,19.79 47.39,19.79 v1(48.3,20.7) ; 228.34,95.84 233.52,95.84 v1(233.72,95.63)
S3: length 400.1
  Top Layer w0.25: v1(254.05,41.02) 253.2,41.87 253.2,55.84 v1(251.5,57.53) 246.43,62.61 v1(246.43,76.58) 242.62,80.39 v1(242.62,95.63) ; v1(65.81,118.39) 65.31,117.9 65.31,115.81 62.09,112.59 59.55,112.59 58.96,112 58.96,108.35 61.77,105.54 67.34,105.54 71.24,101.64 75.9,101.64 77.52,100.03 v1(77.52,93.09) 77.52,91.69 83.78,85.43 83.78,85.36 86.06,83.07 86.06,72.84 v1(86.59,72.32) 86.59,71.93 91.46,67.05 v1(91.46,54.99) 91.46,52.71 v1(91.21,52.45) 82.59,43.84 82.59,29.59 v1(69.9,16.89)
  Bottom Layer w0.25: 256.55,76.89 246.73,76.89 v1(246.43,76.58) ; 83.87,52.83 87,52.83 88.34,51.49 90.25,51.49 v1(91.21,52.45) ; v1(254.05,41.02) 254.05,39.75 253.03,38.74 251.65,38.74 ; 68.25,17.49 68.84,16.89 v1(69.9,16.89) ; v1(77.52,93.09) 76.25,93.09 76.14,92.99 74.45,92.99 ; v1(251.5,57.53) 251.35,57.69 248.9,57.69 246.04,60.54 244.09,60.54 242.56,59.01 242.49,59.08 205.75,59.08 205.71,59.04 204.28,59.04 204.25,59.08 189.68,59.08 187.58,56.97 187.58,56.46 187.41,56.29 186.9,56.29 186.61,56.01 171.31,56.01 168.18,52.88 168.18,52.86 168.01,52.69 150.71,52.69 148.61,50.59 129.61,50.59 128.71,49.69 127.28,49.69 127.24,49.74 108.17,49.74 105.71,52.2 94.26,52.2 v1(91.46,54.99) ; v1(86.59,72.32) 85.91,71.64 83.95,71.64 ; v1(242.62,95.63) 243.22,96.24 247.25,96.24 ; v1(65.81,118.39) 66.13,118.72 66.13,119 66.44,119.31 66.44,120.82
S4: length 411
  Top Layer w0.25: v1(256.58,91.82) 260.39,88.01 v1(260.39,76.58) 261.97,76.58 276.91,61.65 v1(276.91,35.94) ; v1(66.09,117.22) 67.36,117.22 80.83,103.75 80.83,93.87 v1(80.06,93.09) 80.06,89.78 84.18,85.66 84.18,85.53 86.46,83.24 86.46,73.4 87.72,72.14 87.72,71.75 v1(91.63,67.84) 92.42,67.05 92.42,52.06 v1(94.49,49.99) 94.49,49.61 100.16,43.93 v1(100.16,31.92) 100.38,31.71 100.38,15.62 v1(96.56,11.81)
  Bottom Layer w0.25: v1(96.56,11.81) 94.82,11.81 94.45,12.19 ; v1(276.91,35.94) 276.91,35.45 275.64,34.19 ; 98.05,30.59 98.83,30.59 v1(100.16,31.92) ; v1(66.09,117.22) 66.81,117.94 66.58,118.17 66.58,118.81 67.03,119.27 67.09,119.27 67.09,120.82 ; 92.84,88.79 84.36,88.79 v1(80.06,93.09) ; 262.85,76.94 260.75,76.94 v1(260.39,76.58) 260.39,76.2 259.5,75.31 248.97,75.31 247.86,74.21 201.25,74.21 194.36,67.32 186.18,67.32 185.9,67.61 182.83,67.61 182.54,67.32 146.09,67.32 145.2,68.21 93.13,68.21 92.76,67.84 v1(91.63,67.84) ; v1(256.58,91.82) 256.2,91.44 250.24,91.44 ; v1(94.49,49.99) 95.99,48.49 108.34,48.49
S5: length 380.8
  Top Layer w0.25: v1(281.99,105.79) 281.99,110.47 v1(280.72,111.74) ; v1(67.36,118.49) 67.36,117.86 80.88,104.33 87.72,104.33 88.27,103.79 108.73,103.79 115.62,96.9 v1(115.62,86.74) 115.62,85.59 v1(118.21,82.99) 124.51,76.7 v1(124.51,67.53) 114.34,57.37 114.34,52.45 120.7,46.1 v1(120.7,28.93) 124.51,25.12 v1(124.51,10.54)
  Bottom Layer w0.25: 112.65,86.29 113.89,86.29 114.34,86.74 v1(115.62,86.74) ; v1(281.99,105.79) 282.94,104.84 285.25,104.84 ; v1(124.51,10.54) 125.46,9.59 137.25,9.59 ; 114.34,65.53 121.08,65.53 122.23,66.69 122.65,66.69 123.49,67.53 v1(124.51,67.53) ; v1(120.7,28.93) 120.26,28.49 118.05,28.49 ; v1(118.21,82.99) 135.02,82.99 135.74,83.71 144.18,83.71 145.76,82.12 159.12,82.12 159.43,82.43 164.64,82.43 164.95,82.12 167,82.12 169.08,84.2 169.19,84.2 176.41,91.43 188.21,91.43 189.57,92.78 189.57,93.72 189.73,93.88 190.67,93.88 192.8,96.01 192.8,105.43 199.11,111.74 v1(280.72,111.74) ; 67.74,120.82 67.74,118.88 v1(67.36,118.49)
